# EasyEDA Pro project ProProject_IMUSensorNodes202312.epro, board 6_6_拼板20240123（带编号） (continued)
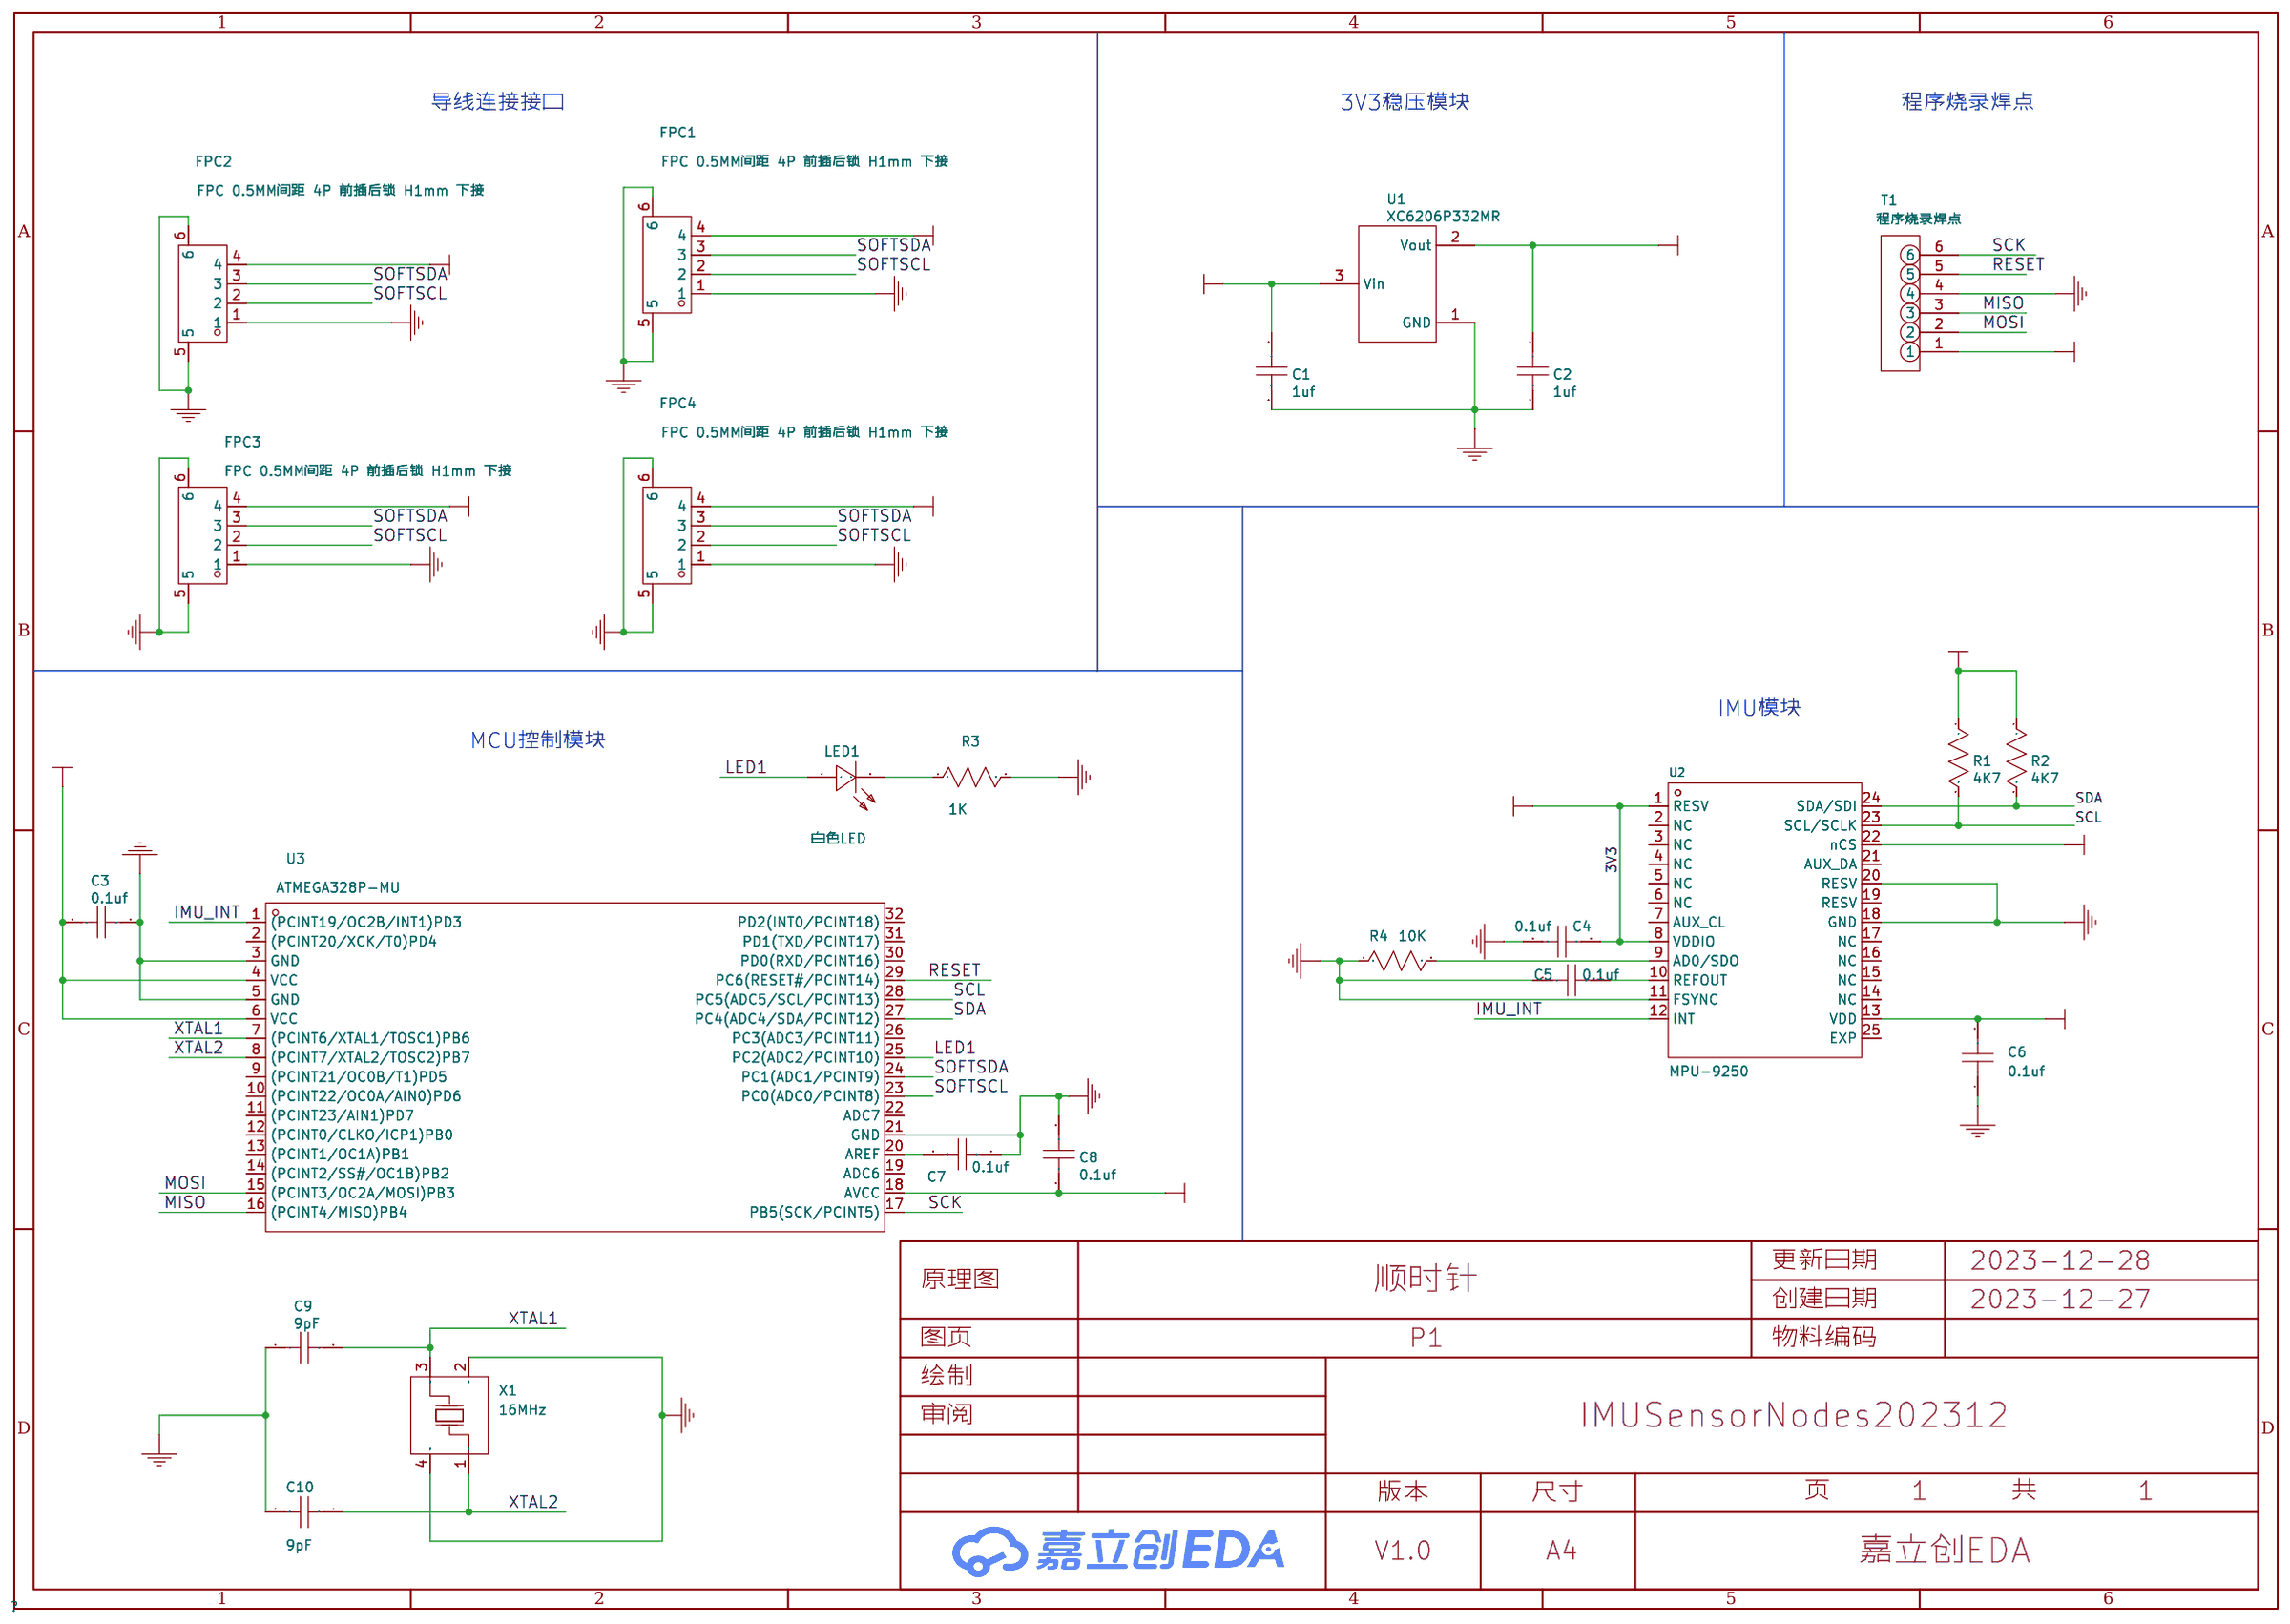
[diagram p0: schematic sheet]
## Routing (per net, layer and track width the routed paths; a pad name or vN(x,y) marks a point on that pad's centre or on a via; arc(x,y) is an arc through that point) (continued)
  Bottom Layer w0.254: 64.55,47.4 64.87,47.72 65.43,47.72 ; 64.55,47.4 64.55,49.81 65.18,50.45 65.18,51.84 64.42,52.61 62.74,52.61 ; 64.55,47.4 64.55,46.66 Designator#776.1 ; Designator#882.22 43.82,37.06 43.47,36.71 v1(43.47,36.35) 43.49,36.33 Designator#477.1 43.49,34.7 46,34.7 46.13,34.57 ; 17.72,38.89 19.29,38.89 ; 17.72,38.89 16.71,38.89 ; 17.72,38.89 arc(17.44,38.78) 17.32,38.5 ; 19.29,38.89 20.01,38.89 ; 19.29,38.89 arc(19.64,38.75) 19.78,38.4 19.78,38.87 ; 44.62,24.78 44.62,25.17 ; 44.62,24.78 Designator#813.1 arc(44.45,25) 44.02,25.17 ; 44.62,24.78 arc(44.74,25.06) 45.02,25.17 ; 1.01,10.7 1.26,10.95 1.3,10.95 ; 1.01,10.7 1.05,10.7 1.3,10.95 ; 1.01,10.7 v1(0.92,10.7) ; Designator#866.2 51.06,60.66 Designator#706.1 ; 73.9,38.89 74.62,38.89 ; 73.9,38.89 72.32,38.89 ; 73.9,38.89 arc(74.25,38.75) 74.39,38.4 74.39,38.87 ; 74.62,38.89 74.65,38.87 ; 74.62,38.89 74.99,38.89 ; 20.96,52.61 21.43,52.61 ; 20.96,52.61 20.38,52.61 ; 20.96,52.61 arc(21.32,52.46) Designator#753.1 ; 21.43,52.61 21.47,52.57 Designator#753.1 ; 21.43,52.61 21.98,52.61 ; 64.55,61.12 64.55,63.53 65.18,64.16 65.18,65.56 64.42,66.32 62.74,66.32 ; 64.55,61.12 64.87,61.44 65.43,61.44 ; 64.55,61.12 64.55,60.38 Designator#716.1 ; 1.01,65.56 1.26,65.81 1.3,65.81 ; 1.01,65.56 1.05,65.56 1.3,65.81 ; 1.01,65.56 v1(0.92,65.56) ; 61.5,66.32 61.73,66.32 arc(62.09,66.17) Designator#723.1 ; v1(75.22,14.89) 74.83,14.51 74.18,14.51 73.92,14.76 Designator#895.18 ; 71.32,25.17 72.32,25.17 ; 71.32,25.17 v1(70.52,25.17) 70.11,24.77 Designator#362.1 ; 71.32,25.17 arc(71.75,25) Designator#883.1 71.93,24.78 ; 72.32,25.17 73.9,25.17 ; 72.32,25.17 arc(72.05,25.06) 71.93,24.78 ; 71.93,65.93 71.93,66.32 ; 71.93,65.93 Designator#881.1 arc(71.75,66.15) 71.32,66.32 ; 71.93,65.93 arc(72.05,66.21) 72.32,66.32 ; Designator#422.1 28.45,50.58 v1(28.35,50.58) ; 28.61,52.1 28.83,52.33 ; 28.61,52.1 Designator#421.1 28.83,52.33 ; 28.61,52.1 28.35,51.84 28.31,51.84 ; 28.61,52.1 28.57,52.1 28.31,51.84 ; 28.83,52.33 29.11,52.61 ; 60.74,11.08 60.74,10.12 Designator#911.8 ; 56.14,66.04 56.42,66.32 ; 56.14,66.04 Designator#409.1 55.91,65.81 ; 56.14,66.04 55.91,65.81 ; Designator#554.1 64.55,19.23 64.55,19.97 ; 37.24,6.25 37.24,5.51 Designator#587.1 ; 37.24,6.25 37.56,6.57 38.12,6.57 ; 37.24,6.25 37.24,8.66 37.88,9.3 37.88,10.7 37.12,11.46 35.44,11.46 ; Designator#706.1 51.06,59.08 50.68,58.7 v1(49.69,58.7) Designator#709.1 ; Designator#706.1 50.93,60.23 50.7,60.23 50.58,60.35 50.58,63.28 51.59,64.29 51.59,65.94 51.21,66.32 49.28,66.32 ; 21.43,80.04 21.47,80 Designator#651.1 ; 21.43,80.04 21.98,80.04 ; 21.43,80.04 20.96,80.04 ; 20.96,66.32 21.43,66.32 ; 20.96,66.32 20.38,66.32 ; 20.96,66.32 arc(21.32,66.17) Designator#693.1 ; 21.43,66.32 21.98,66.32 ; 21.43,66.32 21.47,66.28 Designator#693.1 ; Designator#503.1 78.24,73.94 78.01,73.94 77.88,74.07 77.88,76.99 78.9,78.01 78.9,79.66 78.52,80.04 76.59,80.04 ; Designator#503.1 78.36,72.8 77.98,72.42 v1(76.99,72.42) Designator#506.1 ; Designator#503.1 78.36,74.37 Designator#845.2 ; 9.94,19.97 10.26,20.29 10.82,20.29 ; 9.94,19.97 9.94,22.38 10.57,23.02 10.57,24.41 9.81,25.17 8.13,25.17 ; 9.94,19.97 9.94,19.23 Designator#513.1 ; Designator#333.1 28.45,36.86 v1(28.35,36.86) ; Designator#864.2 23.75,60.66 Designator#686.1 ; 1.3,38.38 1.53,38.61 ; 1.3,38.38 1.05,38.13 1.01,38.13 ; 1.3,38.38 Designator#433.1 1.53,38.61 ; 1.3,38.38 1.26,38.38 1.01,38.13 ; 1.53,38.61 1.81,38.89 ; 21.98,80.04 23.91,80.04 24.29,79.66 24.29,78.01 23.27,76.99 23.27,74.07 23.4,73.94 23.63,73.94 Designator#643.1 ; 21.98,80.04 arc(21.62,79.89) Designator#651.1 ; Designator#883.22 71.12,23.34 70.77,22.99 v1(70.77,22.64) 70.8,22.61 Designator#566.1 70.8,20.98 73.31,20.98 73.44,20.86 ; 56.14,24.9 56.42,25.17 ; 56.14,24.9 Designator#359.1 55.91,24.67 ; 56.14,24.9 55.91,24.67 ; 21.98,52.61 23.91,52.61 24.29,52.23 24.29,50.58 23.27,49.56 23.27,46.64 23.4,46.51 23.63,46.51 Designator#746.1 ; 21.98,52.61 arc(21.62,52.46) Designator#753.1 ; Designator#888.8 6.13,51.27 6.13,52.23 ; v1(69.55,36.86) 69.55,36.91 69.88,37.24 Designator#342.1 ; Designator#763.1 34.93,52.58 34.96,52.61 35.44,52.61 ; Designator#763.1 arc(34.78,52.46) 34.42,52.61 34.19,52.61 ; Designator#763.1 arc(35.08,52.46) 35.44,52.61 ; 75.57,66.32 76.04,66.32 ; 75.57,66.32 74.99,66.32 ; 75.57,66.32 arc(75.93,66.17) Designator#733.1 ; 76.04,66.32 76.08,66.28 Designator#733.1 ; 76.04,66.32 76.59,66.32 ; 28.61,38.38 28.83,38.61 ; 28.61,38.38 28.35,38.13 28.31,38.13 ; 28.61,38.38 Designator#332.1 28.83,38.61 ; 28.61,38.38 28.57,38.38 28.31,38.13 ; 28.83,38.61 29.11,38.89 ; 20.01,38.89 20.38,38.89 ; 20.01,38.89 20.04,38.87 ; 49.28,52.61 51.21,52.61 51.59,52.23 51.59,50.58 50.58,49.56 50.58,46.64 50.7,46.51 50.93,46.51 Designator#766.1 ; 49.28,52.61 48.73,52.61 ; 49.28,52.61 arc(48.92,52.46) Designator#773.1 ; v1(75.22,42.32) 74.83,41.94 74.18,41.94 73.92,42.19 Designator#906.18 ; Designator#686.1 23.75,59.08 23.37,58.7 v1(22.38,58.7) Designator#689.1 ; Designator#686.1 23.63,60.23 23.4,60.23 23.27,60.35 23.27,63.28 24.29,64.29 24.29,65.94 23.91,66.32 21.98,66.32 ; 48.27,52.61 48.73,52.61 ; 48.27,52.61 47.69,52.61 ; 48.27,52.61 arc(48.62,52.46) Designator#773.1 ; 48.73,52.61 48.77,52.57 Designator#773.1 ; Designator#510.1 76.08,80 76.04,80.04 ; Designator#510.1 arc(76.23,79.89) 76.59,80.04 ; Designator#510.1 arc(75.93,79.89) 75.57,80.04 ; Designator#811.6 5.11,61.25 v2(5.11,62.2) 5.17,62.26 5.49,62.26 5.6,62.37 Designator#818.13 ; Designator#597.1 51.06,5.79 Designator#855.2 ; Designator#597.1 50.93,5.36 50.7,5.36 50.58,5.49 50.58,8.41 51.59,9.43 51.59,11.08 51.21,11.46 49.28,11.46 ; Designator#597.1 51.06,4.22 50.68,3.84 v1(49.69,3.84) Designator#600.1 ; Designator#360.1 55.76,23.14 v1(55.66,23.14) ; 64.55,74.83 64.55,74.09 Designator#637.1 ; 64.55,74.83 64.55,77.25 65.18,77.88 65.18,79.28 64.42,80.04 62.74,80.04 ; 64.55,74.83 64.87,75.15 65.43,75.15 ; 18.83,62 18.7,62.13 16.19,62.13 Designator#690.1 16.19,63.76 v1(16.16,63.78) 16.16,64.14 16.51,64.49 Designator#915.22 ; 48.27,66.32 47.69,66.32 ; 48.27,66.32 48.73,66.32 ; 48.27,66.32 arc(48.62,66.17) Designator#713.1 ; 47.69,66.32 47.32,66.32 ; 47.69,66.32 arc(47.26,66.15) 47.09,65.72 ; Designator#407.1 42.58,64.67 42.25,64.34 v1(42.25,64.29) ; Designator#604.1 48.77,11.42 48.73,11.46 ; Designator#604.1 arc(48.92,11.31) 49.28,11.46 ; Designator#604.1 arc(48.62,11.31) 48.27,11.46 ; 35.44,11.46 34.96,11.46 34.93,11.43 Designator#594.1 ; 35.44,11.46 arc(35.08,11.31) Designator#594.1 ; 65.43,34 64.87,34 64.55,33.68 ; 47.09,11.44 47.09,10.97 arc(46.94,11.31) 46.59,11.46 ; 34.19,11.46 34.42,11.46 arc(34.78,11.31) Designator#594.1 ; 38.12,47.72 37.56,47.72 37.24,47.4 ; 34.19,25.17 34.42,25.17 arc(34.78,25.03) Designator#540.1 ; 61.5,25.17 61.73,25.17 arc(62.09,25.03) Designator#559.1 ; Designator#840.2 23.75,33.22 Designator#453.1 ; v1(42.25,9.43) 42.25,9.48 42.58,9.81 Designator#374.1 ; 28.31,79.28 28.35,79.28 28.61,79.53 ; 28.31,79.28 28.57,79.53 28.61,79.53 ; 28.31,79.28 v1(28.22,79.28) ; Designator#394.1 42.8,79.63 v1(43.21,80.04) 44.02,80.04 ; 20.96,80.04 20.38,80.04 ; 20.96,80.04 arc(21.32,79.89) Designator#651.1 ; 20.38,80.04 20.01,80.04 ; 20.38,80.04 arc(19.96,79.86) 19.78,79.44 ; 8.13,38.89 7.65,38.89 7.63,38.87 Designator#450.1 ; 8.13,38.89 9.81,38.89 10.57,38.13 10.57,36.73 9.94,36.1 9.94,33.68 ; 8.13,38.89 arc(7.77,38.74) Designator#450.1 ; v1(1.05,50.58) 1.15,50.58 Designator#416.1 ; Designator#830.22 71.12,37.06 70.77,36.71 v1(70.77,36.35) 70.8,36.33 Designator#497.1 70.8,34.7 73.31,34.7 73.44,34.57 ; 28.61,79.53 28.83,79.76 ; 28.61,79.53 Designator#391.1 28.83,79.76 ; 71.93,79.64 Designator#918.1 arc(71.75,79.86) 71.32,80.04 ; 71.93,79.64 71.93,80.04 ; 71.93,79.64 arc(72.05,79.92) 72.32,80.04 ; 71.93,52.21 71.93,52.61 ; 71.93,52.21 Designator#912.1 arc(71.75,52.43) 71.32,52.61 ; 71.93,52.21 arc(72.05,52.49) 72.32,52.61 ; 6.89,52.61 7.12,52.61 arc(7.48,52.46) Designator#743.1 ; 21.98,66.32 arc(21.62,66.17) Designator#693.1 ; 56.14,52.33 56.42,52.61 ; 56.14,52.33 55.91,52.1 ; 56.14,52.33 Designator#427.1 55.91,52.1 ; 48.73,38.89 49.28,38.89 ; 48.73,38.89 48.77,38.85 Designator#480.1 ; 48.73,38.89 48.27,38.89 ; 49.28,38.89 51.21,38.89 51.59,38.51 51.59,36.86 50.58,35.84 50.58,32.92 50.7,32.8 50.93,32.8 Designator#473.1 ; 49.28,38.89 arc(48.92,38.74) Designator#480.1 ; 44.62,52.21 Designator#897.1 arc(44.45,52.43) 44.02,52.61 ; 44.62,52.21 44.62,52.61 ; 44.62,52.21 arc(44.74,52.49) 45.02,52.61 ; Designator#580.1 v1(22.38,3.84) 23.37,3.84 23.75,4.22 Designator#577.1 ; 74.39,25.15 74.39,24.68 arc(74.25,25.03) 73.9,25.17 ; 28.31,51.84 v1(28.22,51.84) ; 16.71,38.89 v1(15.91,38.89) 15.5,38.48 Designator#329.1 ; 16.71,38.89 arc(17.14,38.71) Designator#923.1 17.32,38.5 ; Designator#877.13 60.21,48.65 60.1,48.54 59.78,48.54 v2(59.72,48.48) 59.72,47.53 Designator#920.6 ; 20.04,52.58 20.01,52.61 ; 20.01,52.61 19.29,52.61 ; 20.01,52.61 20.38,52.61 ; 46.13,48.29 46,48.42 43.49,48.42 Designator#770.1 43.49,50.04 v1(43.47,50.07) 43.47,50.42 43.82,50.78 Designator#897.22 ; 74.65,52.58 74.62,52.61 ; 74.62,52.61 73.9,52.61 ; 74.62,52.61 74.99,52.61 ; 44.02,38.89 v1(43.21,38.89) 42.8,38.48 Designator#335.1 ; 44.02,38.89 45.02,38.89 ; 44.02,38.89 arc(44.45,38.71) Designator#882.1 44.62,38.5 ; 44.62,79.64 Designator#880.1 arc(44.45,79.86) 44.02,80.04 ; 44.62,79.64 44.62,80.04 ; 44.62,79.64 arc(44.74,79.92) 45.02,80.04 ; 47.34,80.02 47.32,80.04 ; 47.32,80.04 47.69,80.04 ; 47.32,80.04 46.59,80.04 ; 8.13,11.46 7.65,11.46 7.63,11.43 Designator#574.1 ; 8.13,11.46 9.81,11.46 10.57,10.7 10.57,9.3 9.94,8.66 9.94,6.25 ; 8.13,11.46 arc(7.77,11.31) Designator#574.1 ; Designator#801.18 73.92,28.48 74.18,28.22 74.83,28.22 v1(75.22,28.6) ; 28.61,10.95 28.35,10.7 28.31,10.7 ; 28.61,10.95 28.83,11.18 ; 28.61,10.95 28.57,10.95 28.31,10.7 ; 28.61,10.95 Designator#370.1 28.83,11.18 ; Designator#400.1 15.5,65.92 v1(15.91,66.32) 16.71,66.32 ; Designator#646.1 v1(22.38,72.42) 23.37,72.42 23.75,72.8 Designator#643.1 ; 6.89,25.17 7.12,25.17 arc(7.48,25.03) Designator#520.1 ; 8.13,80.04 9.81,80.04 10.57,79.28 10.57,77.88 9.94,77.25 9.94,74.83 ; 8.13,80.04 7.65,80.04 7.63,80.01 Designator#634.1 ; 8.13,80.04 arc(7.77,79.89) Designator#634.1 ; 9.94,61.12 10.26,61.44 10.82,61.44 ; 9.94,61.12 9.94,60.38 Designator#676.1 ; 9.94,61.12 9.94,63.53 10.57,64.16 10.57,65.56 9.81,66.32 8.13,66.32 ; 47.69,52.61 47.32,52.61 ; 47.69,52.61 arc(47.26,52.43) 47.09,52 ; Designator#847.2 23.75,19.51 Designator#523.1 ; Designator#551.1 48.77,25.14 48.73,25.17 ; Designator#551.1 arc(48.92,25.03) 49.28,25.17 ; Designator#551.1 arc(48.62,25.03) 48.27,25.17 ; 55.62,24.41 55.87,24.67 55.91,24.67 ; 55.62,24.41 55.66,24.41 55.91,24.67 ; 55.62,24.41 v1(55.53,24.41) ; Designator#523.1 23.63,19.08 23.4,19.08 23.27,19.21 23.27,22.13 24.29,23.14 24.29,24.79 23.91,25.17 21.98,25.17 ; Designator#523.1 23.75,17.94 23.37,17.56 v1(22.38,17.56) Designator#526.1 ; 47.69,80.04 48.27,80.04 ; 47.69,80.04 arc(47.26,79.86) 47.09,79.44 ; Designator#872.2 51.06,46.94 Designator#766.1 ; Designator#620.1 v1(76.99,3.84) 77.98,3.84 78.36,4.22 Designator#617.1 ; Designator#463.1 37.24,32.95 37.24,33.68 ; 55.91,10.95 55.87,10.95 55.62,10.7 ; 55.91,10.95 55.66,10.7 55.62,10.7 ; 55.91,10.95 56.14,11.18 ; 55.91,10.95 Designator#376.1 56.14,11.18 ; 62.74,66.32 62.26,66.32 62.24,66.3 Designator#723.1 ; 62.74,66.32 arc(62.38,66.17) Designator#723.1 ; Designator#419.1 15.27,50.96 14.94,50.63 v1(14.94,50.58) ; Designator#348.1 1.15,23.14 v1(1.05,23.14) ; 16.71,52.61 17.72,52.61 ; 16.71,52.61 v1(15.91,52.61) 15.5,52.2 Designator#418.1 ; 16.71,52.61 arc(17.14,52.43) Designator#890.1 17.32,52.21 ; 17.72,52.61 19.29,52.61 ; 17.72,52.61 arc(17.44,52.49) 17.32,52.21 ; 74.65,80.02 74.62,80.04 ; 74.62,80.04 73.9,80.04 ; 74.62,80.04 74.99,80.04 ; 28.83,66.04 Designator#403.1 28.61,65.81 ; 28.83,66.04 28.61,65.81 ; 28.83,66.04 29.11,66.32 ; Designator#456.1 v1(22.38,31.27) 23.37,31.27 23.75,31.65 Designator#453.1 ; 61.5,11.46 61.73,11.46 arc(62.09,11.31) Designator#614.1 ; v1(55.53,79.28) 55.62,79.28 ; 55.62,79.28 55.87,79.53 55.91,79.53 ; 55.62,79.28 55.66,79.28 55.91,79.53 ; 28.83,11.18 29.11,11.46 ; Designator#868.2 78.36,60.66 Designator#726.1 ; Designator#428.1 55.76,50.58 v1(55.66,50.58) ; 62.74,11.46 62.26,11.46 62.24,11.43 Designator#614.1 ; 62.74,11.46 64.42,11.46 65.18,10.7 65.18,9.3 64.55,8.66 64.55,6.25 ; 62.74,11.46 arc(62.38,11.31) Designator#614.1 ; Designator#877.8 60.74,51.27 60.74,52.23 ; 28.83,79.76 29.11,80.04 ; 73.44,62 73.31,62.13 70.8,62.13 Designator#730.1 70.8,63.76 v1(70.77,63.78) 70.77,64.14 71.12,64.49 Designator#881.22 ; 48.73,66.32 48.77,66.28 Designator#713.1 ; 48.73,66.32 49.28,66.32 ; Designator#862.2 51.06,74.37 Designator#666.1 ; 19.29,66.32 20.01,66.32 ; 19.29,66.32 17.72,66.32 ; 19.29,66.32 arc(19.64,66.18) 19.78,65.83 19.78,66.3 ; 20.01,66.32 20.04,66.3 ; 20.01,66.32 20.38,66.32 ; 76.04,80.04 76.59,80.04 ; 76.04,80.04 75.57,80.04 ; 34.19,66.32 34.42,66.32 arc(34.78,66.17) Designator#703.1 ; Designator#425.1 42.58,50.96 42.25,50.63 v1(42.25,50.58) ; 44.62,65.93 Designator#314.1 arc(44.45,66.15) 44.02,66.32 ; 44.62,65.93 44.62,66.32 ; 44.62,65.93 arc(44.74,66.21) 45.02,66.32 ; 44.02,52.61 45.02,52.61 ; 44.02,52.61 v1(43.21,52.61) 42.8,52.2 Designator#424.1 ; 45.02,52.61 46.59,52.61 ; 55.91,79.53 Designator#385.1 56.14,79.76 ; 55.91,79.53 56.14,79.76 ; Designator#713.1 arc(48.92,66.17) 49.28,66.32 ; 60.74,79.66 60.74,78.7 Designator#814.8 ; Designator#766.1 51.06,45.37 50.68,44.99 v1(49.69,44.99) Designator#769.1 ; 17.72,11.46 19.29,11.46 ; 17.72,11.46 16.71,11.46 ; 17.72,11.46 arc(17.44,11.34) 17.32,11.06 ; 19.29,11.46 20.01,11.46 ; 19.29,11.46 arc(19.64,11.31) 19.78,10.97 19.78,11.44 ; 44.02,11.46 v1(43.21,11.46) 42.8,11.05 Designator#373.1 ; 44.02,11.46 45.02,11.46 ; 44.02,11.46 arc(44.45,11.28) Designator#326.1 44.62,11.06 ; 44.2,78.21 43.82,78.21 43.47,77.86 v1(43.47,77.5) 43.49,77.47 Designator#670.1 43.49,75.85 46,75.85 46.13,75.72 ; Designator#389.1 15.27,78.39 14.94,78.06 v1(14.94,78.01) ; 45.02,38.89 46.59,38.89 ; 45.02,38.89 arc(44.74,38.78) 44.62,38.5 ; 35.44,80.04 34.96,80.04 34.93,80.01 Designator#663.1 ; 35.44,80.04 37.12,80.04 37.88,79.28 37.88,77.88 37.24,77.25 37.24,74.83 ; 35.44,80.04 arc(35.08,79.89) Designator#663.1 ; 1.53,79.76 Designator#382.1 1.3,79.53 ; 1.53,79.76 1.3,79.53 ; 1.53,79.76 1.81,80.04 ; 71.93,24.78 71.93,25.17 ; 73.9,66.32 74.62,66.32 ; 73.9,66.32 72.32,66.32 ; 73.9,66.32 arc(74.25,66.18) 74.39,65.83 74.39,66.3 ; 74.62,66.32 74.99,66.32 ; 74.62,66.32 74.65,66.3 ; Designator#453.1 23.63,32.8 23.4,32.8 23.27,32.92 23.27,35.84 24.29,36.86 24.29,38.51 23.91,38.89 21.98,38.89 ; 17.72,80.04 19.29,80.04 ; 17.72,80.04 16.71,80.04 ; 17.72,80.04 arc(17.44,79.92) 17.32,79.64 ; 19.29,80.04 20.01,80.04 ; 19.29,80.04 arc(19.64,79.89) 19.78,79.55 19.78,80.02 ; Designator#909.13 32.91,21.22 32.8,21.11 32.48,21.11 v2(32.42,21.05) 32.42,20.1 Designator#321.6 ; 9.94,33.68 10.26,34 10.82,34 ; 9.94,33.68 9.94,32.95 Designator#796.1 ; v1(42.25,23.14) 42.25,23.19 42.58,23.52 Designator#357.1 ; 16.71,80.04 v1(15.91,80.04) 15.5,79.63 Designator#388.1 ; 16.71,80.04 arc(17.14,79.86) Designator#886.1 17.32,79.64 ; 16.89,78.21 16.51,78.21 16.16,77.86 v1(16.16,77.5) 16.19,77.47 Designator#647.1 16.19,75.85 18.7,75.85 18.83,75.72 ; Designator#663.1 arc(34.78,79.89) 34.42,80.04 34.19,80.04 ; Designator#565.1 v1(76.99,17.56) 77.98,17.56 78.36,17.94 Designator#562.1 ; Designator#473.1 51.06,31.65 50.68,31.27 v1(49.69,31.27) Designator#476.1 ; Designator#473.1 51.06,33.22 Designator#842.2 ; 1.3,52.1 Designator#415.1 1.53,52.33 ; 1.3,52.1 1.26,52.1 1.01,51.84 ; 1.3,52.1 1.53,52.33 ; 1.3,52.1 1.05,51.84 1.01,51.84 ; 76.04,11.46 76.59,11.46 ; 76.04,11.46 75.57,11.46 ; 76.04,11.46 76.08,11.42 Designator#624.1 ; 76.59,11.46 78.52,11.46 78.9,11.08 78.9,9.43 77.88,8.41 77.88,5.49 78.01,5.36 78.24,5.36 Designator#617.1 ; 76.59,11.46 arc(76.23,11.31) Designator#624.1 ; 20.01,11.46 20.38,11.46 ; 20.01,11.46 20.04,11.44 ; 20.38,11.46 20.96,11.46 ; 20.38,11.46 arc(19.96,11.28) 19.78,10.86 ; Designator#345.1 69.88,78.39 69.55,78.06 v1(69.55,78.01) ; 71.93,38.5 Designator#830.1 arc(71.75,38.71) 71.32,38.89 ; 71.93,38.5 71.93,38.89 ; 71.93,38.5 arc(72.05,38.78) 72.32,38.89 ; 18.83,20.86 18.7,20.98 16.19,20.98 Designator#527.1 16.19,22.61 v1(16.16,22.64) 16.16,22.99 16.51,23.34 Designator#836.22 ; Designator#819.13 60.21,62.37 60.1,62.26 59.78,62.26 v2(59.72,62.2) 59.72,61.25 Designator#896.6 ; 71.93,11.06 Designator#826.1 arc(71.75,11.28) 71.32,11.46 ; 71.93,11.06 71.93,11.46 ; 71.93,11.06 arc(72.05,11.34) 72.32,11.46 ; 76.59,25.17 78.52,25.17 78.9,24.79 78.9,23.14 77.88,22.13 77.88,19.21 78.01,19.08 78.24,19.08 Designator#562.1 ; 76.59,25.17 76.04,25.17 ; 76.59,25.17 arc(76.23,25.03) Designator#445.1 ; 1.3,65.81 Designator#397.1 1.53,66.04 ; 1.3,65.81 1.53,66.04 ; 48.73,80.04 48.77,80 Designator#673.1 ; 48.73,80.04 48.27,80.04 ; 48.73,80.04 49.28,80.04 ; Designator#746.1 23.75,46.94 Designator#870.2 ; Designator#746.1 23.75,45.37 23.37,44.99 v1(22.38,44.99) Designator#749.1 ; 6.13,11.08 6.13,10.12 Designator#438.8 ; 71.32,66.32 72.32,66.32 ; 71.32,66.32 v1(70.52,66.32) 70.11,65.92 Designator#412.1 ; v1(0.92,51.84) 1.01,51.84 ; 55.91,65.81 55.66,65.56 55.62,65.56 ; 55.91,65.81 55.87,65.81 55.62,65.56 ; 35.44,25.17 34.96,25.17 34.93,25.15 Designator#540.1 ; 35.44,25.17 37.12,25.17 37.88,24.41 37.88,23.02 37.24,22.38 37.24,19.97 ; 35.44,25.17 arc(35.08,25.03) Designator#540.1 ; 75.57,38.89 74.99,38.89 ; 75.57,38.89 76.04,38.89 ; 75.57,38.89 arc(75.93,38.74) Designator#500.1 ; 74.99,38.89 arc(74.57,38.71) 74.39,38.29 ; 33.43,65.94 33.43,64.99 Designator#878.8 ; 76.04,38.89 76.59,38.89 ; 76.04,38.89 76.08,38.85 Designator#500.1 ; 76.59,38.89 78.52,38.89 78.9,38.51 78.9,36.86 77.88,35.84 77.88,32.92 78.01,32.8 78.24,32.8 Designator#493.1 ; 76.59,38.89 arc(76.23,38.74) Designator#500.1 ; v1(1.05,36.86) 1.15,36.86 Designator#434.1 ; Designator#729.1 v1(76.99,58.7) 77.98,58.7 78.36,59.08 Designator#726.1 ; 35.44,52.61 37.12,52.61 37.88,51.84 37.88,50.45 37.24,49.81 37.24,47.4 ; 45.02,25.17 46.59,25.17 ; 45.02,25.17 44.02,25.17 ; 46.59,25.17 47.32,25.17 ; 46.59,25.17 arc(46.94,25.03) 47.09,24.68 47.09,25.15 ; Designator#351.1 15.27,23.52 14.94,23.19 v1(14.94,23.14) ; Designator#341.1 70.11,38.48 v1(70.52,38.89) 71.32,38.89 ; Designator#398.1 1.15,64.29 v1(1.05,64.29) ; Designator#325.6 5.11,74.97 v2(5.11,75.91) 5.17,75.97 5.49,75.97 5.6,76.09 Designator#437.13 ; 33.43,24.79 33.43,23.84 Designator#909.8 ; Designator#793.1 76.08,52.57 76.04,52.61 ; Designator#793.1 arc(75.93,52.46) 75.57,52.61 ; Designator#793.1 arc(76.23,52.46) 76.59,52.61 ; Designator#319.13 32.91,48.65 32.8,48.54 32.48,48.54 v2(32.42,48.48) 32.42,47.53 Designator#916.6 ; 44.02,25.17 v1(43.21,25.17) 42.8,24.77 Designator#356.1 ; Designator#543.1 50.93,19.08 50.7,19.08 50.58,19.21 50.58,22.13 51.59,23.14 51.59,24.79 51.21,25.17 49.28,25.17 ; Designator#543.1 51.06,19.51 Designator#849.2 ; Designator#543.1 51.06,17.94 50.68,17.56 v1(49.69,17.56) Designator#546.1 ; 48.27,80.04 arc(48.62,79.89) Designator#673.1 ; 9.94,74.83 9.94,74.09 Designator#627.1 ; 9.94,74.83 10.26,75.15 10.82,75.15 ; Designator#493.1 78.36,33.22 Designator#844.2 ; Designator#493.1 78.36,31.65 77.98,31.27 v1(76.99,31.27) Designator#496.1 ; Designator#404.1 28.45,64.29 v1(28.35,64.29) ; Designator#548.1 62.24,80.01 62.26,80.04 62.74,80.04 ; Designator#548.1 arc(62.38,79.89) 62.74,80.04 ; Designator#548.1 arc(62.09,79.89) 61.73,80.04 61.5,80.04 ; 75.57,52.61 74.99,52.61 ; 75.57,52.61 76.04,52.61 ; 74.99,52.61 arc(74.57,52.43) 74.39,52 ; 48.27,11.46 47.69,11.46 ; 48.27,11.46 48.73,11.46 ; 47.69,11.46 47.32,11.46 ; 47.69,11.46 arc(47.26,11.28) 47.09,10.86 ; 44.62,11.06 44.62,11.46 ; 44.62,11.06 arc(44.74,11.34) 45.02,11.46 ; Designator#810.18 73.92,69.62 74.18,69.37 74.83,69.37 v1(75.22,69.75) ; 6.89,80.04 7.12,80.04 arc(7.48,79.89) Designator#634.1 ; 17.32,24.78 17.32,25.17 ; 17.32,24.78 Designator#836.1 arc(17.14,25) 16.71,25.17 ; 17.32,24.78 arc(17.44,25.06) 17.72,25.17 ; Designator#919.13 60.21,34.94 60.1,34.83 59.78,34.83 v2(59.72,34.76) 59.72,33.82 Designator#892.6 ; 1.53,24.9 Designator#347.1 1.3,24.67 ; 1.53,24.9 1.3,24.67 ; 1.53,24.9 1.81,25.17 ; Designator#736.1 9.94,46.66 9.94,47.4 ; 74.65,25.15 74.62,25.17 ; 74.62,25.17 74.99,25.17 ; 74.62,25.17 73.9,25.17 ; 9.94,47.4 10.26,47.72 10.82,47.72 ; 9.94,47.4 9.94,49.81 10.57,50.45 10.57,51.84 9.81,52.61 8.13,52.61 ; 76.04,52.61 76.59,52.61 ; 71.32,52.61 v1(70.52,52.61) 70.11,52.2 Designator#430.1 ; 71.32,52.61 72.32,52.61 ; 33.43,38.51 33.43,37.56 Designator#921.8 ; 73.9,52.61 72.32,52.61 ; 73.9,52.61 arc(74.25,52.46) 74.39,52.11 74.39,52.58 ; 20.01,80.04 20.04,80.02 ; 75.57,11.46 74.99,11.46 ; 75.57,11.46 arc(75.93,11.31) Designator#624.1 ; 74.99,11.46 74.62,11.46 ; 74.99,11.46 arc(74.57,11.28) 74.39,10.86 ; v1(28.35,23.14) 28.45,23.14 Designator#354.1 ; 19.78,25.15 19.78,24.68 arc(19.64,25.03) 19.29,25.17 ; Designator#313.6 32.42,74.97 v2(32.42,75.91) 32.48,75.97 32.8,75.97 32.91,76.09 Designator#901.13 ; 47.34,38.87 47.32,38.89 ; 47.32,38.89 47.69,38.89 ; 47.32,38.89 46.59,38.89 ; 1.3,79.53 1.05,79.28 1.01,79.28 ; 1.3,79.53 1.26,79.53 1.01,79.28 ; v1(55.66,78.01) 55.76,78.01 Designator#386.1 ; 16.71,66.32 17.72,66.32 ; 16.71,66.32 arc(17.14,66.15) Designator#915.1 17.32,65.93 ; Designator#567.1 9.94,5.51 9.94,6.25 ; 38.12,20.29 37.56,20.29 37.24,19.97 ; v1(55.66,36.86) 55.76,36.86 Designator#339.1 ; Designator#438.13 5.6,7.51 5.49,7.4 5.17,7.4 v2(5.11,7.33) 5.11,6.39 Designator#917.6 ; Designator#406.1 42.8,65.92 v1(43.21,66.32) 44.02,66.32 ; Designator#643.1 23.75,74.37 Designator#860.2 ; 55.62,38.13 55.66,38.13 55.91,38.38 ; 55.62,38.13 55.87,38.38 55.91,38.38 ; 55.62,38.13 v1(55.53,38.13) ; Designator#888.13 5.6,48.65 5.49,48.54 5.17,48.54 v2(5.11,48.48) 5.11,47.53 Designator#803.6 ; 48.73,25.17 49.28,25.17 ; 48.73,25.17 48.27,25.17 ; Designator#533.1 37.24,19.23 37.24,19.97 ; 60.74,38.51 60.74,37.56 Designator#919.8 ; 47.09,80.02 47.09,79.55 arc(46.94,79.89) 46.59,80.04 ; 1.53,66.04 1.81,66.32 ; Designator#885.18 46.62,14.76 46.87,14.51 47.53,14.51 v1(47.91,14.89) ; 48.27,38.89 47.69,38.89 ; 48.27,38.89 arc(48.62,38.74) Designator#480.1 ; 47.69,38.89 arc(47.26,38.71) 47.09,38.29 ; 76.59,66.32 78.52,66.32 78.9,65.94 78.9,64.29 77.88,63.28 77.88,60.35 78.01,60.23 78.24,60.23 Designator#726.1 ; 76.59,66.32 arc(76.23,66.17) Designator#733.1 ; 37.24,61.12 37.24,63.53 37.88,64.16 37.88,65.56 37.12,66.32 35.44,66.32 ; 37.24,61.12 37.56,61.44 38.12,61.44 ; 37.24,61.12 37.24,60.38 Designator#696.1 ; v1(1.05,9.43) 1.15,9.43 Designator#365.1 ; Designator#336.1 42.58,37.24 42.25,36.91 v1(42.25,36.86) ; Designator#827.6 32.42,33.82 v2(32.42,34.76) 32.48,34.83 32.8,34.83 32.91,34.94 Designator#921.13 ; Designator#470.1 34.93,38.87 34.96,38.89 35.44,38.89 ; Designator#470.1 arc(34.78,38.74) 34.42,38.89 34.19,38.89 ; Designator#470.1 arc(35.08,38.74) 35.44,38.89 ; Designator#559.1 62.24,25.15 62.26,25.17 62.74,25.17 ; Designator#559.1 arc(62.38,25.03) 62.74,25.17 ; Designator#901.8 33.43,78.7 33.43,79.66 ; 8.13,52.61 7.65,52.61 7.63,52.58 Designator#743.1 ; 8.13,52.61 arc(7.77,52.46) Designator#743.1 ; 74.99,66.32 arc(74.57,66.15) 74.39,65.72 ; 1.3,24.67 1.26,24.67 1.01,24.41 ; 1.3,24.67 1.05,24.41 1.01,24.41 ; 48.27,25.17 47.69,25.17 ; 47.69,25.17 47.32,25.17 ; 47.69,25.17 arc(47.26,25) 47.09,24.57 ; Designator#368.1 15.27,9.81 14.94,9.48 v1(14.94,9.43) ; v1(47.91,28.6) 47.53,28.22 46.87,28.22 46.62,28.48 Designator#839.18 ; 47.32,66.32 46.59,66.32 ; 47.32,66.32 47.34,66.3 ; v1(0.92,24.41) 1.01,24.41 ; 47.32,52.61 47.34,52.58 ; 47.32,52.61 46.59,52.61 ; 55.62,51.84 55.87,52.1 55.91,52.1 ; 55.62,51.84 55.66,51.84 55.91,52.1 ; 55.62,51.84 v1(55.53,51.84) ; 48.73,11.46 49.28,11.46 ; 56.14,11.18 56.42,11.46 ; 71.32,38.89 72.32,38.89 ; Designator#819.8 60.74,64.99 60.74,65.94 ; Designator#904.18 19.31,14.76 19.57,14.51 20.22,14.51 v1(20.6,14.89) ; 73.44,75.72 73.31,75.85 70.8,75.85 Designator#507.1 70.8,77.47 v1(70.77,77.5) 70.77,77.86 71.12,78.21 71.5,78.21 ; 65.43,20.29 64.87,20.29 64.55,19.97 ; 56.14,38.61 Designator#338.1 55.91,38.38 ; 56.14,38.61 55.91,38.38 ; 56.14,38.61 56.42,38.89 ; v1(14.94,64.29) 14.94,64.34 15.27,64.67 Designator#401.1 ; 1.53,11.18 1.81,11.46 ; 1.53,11.18 1.3,10.95 ; 1.53,11.18 Designator#364.1 1.3,10.95 ; v1(47.91,56.04) 47.53,55.66 46.87,55.66 46.62,55.91 Designator#324.18 ; 56.14,79.76 56.42,80.04 ; Designator#330.1 15.27,37.24 14.94,36.91 v1(14.94,36.86) ; Designator#818.8 6.13,64.99 6.13,65.94 ; Designator#806.6 32.42,6.39 v2(32.42,7.33) 32.48,7.4 32.8,7.4 32.91,7.51 Designator#831.13 ; 37.24,33.68 37.24,36.1 37.88,36.73 37.88,38.13 37.12,38.89 35.44,38.89 ; 37.24,33.68 37.56,34 38.12,34 ; 19.29,25.17 20.01,25.17 ; 19.29,25.17 17.72,25.17 ; 20.01,25.17 20.04,25.15 ; 20.01,25.17 20.38,25.17 ; Designator#326.22 43.82,9.63 43.47,9.28 v1(43.47,8.92) 43.49,8.89 Designator#601.1 43.49,7.27 46,7.27 46.13,7.14 ; 64.55,33.68 64.55,32.95 Designator#483.1 ; 64.55,33.68 64.55,36.1 65.18,36.73 65.18,38.13 64.42,38.89 62.74,38.89 ; 28.31,65.56 28.57,65.81 28.61,65.81 ; 28.31,65.56 v1(28.22,65.56) ; 28.31,65.56 28.35,65.56 28.61,65.81 ; v1(28.22,24.41) 28.31,24.41 ; 28.31,24.41 28.35,24.41 28.61,24.67 ; 28.31,24.41 28.57,24.67 28.61,24.67 ; Designator#669.1 v1(49.69,72.42) 50.68,72.42 51.06,72.8 Designator#666.1 ; 8.13,25.17 7.65,25.17 7.63,25.15 Designator#520.1 ; 8.13,25.17 arc(7.77,25.03) Designator#520.1 ; 33.43,52.23 33.43,51.27 Designator#319.8 ; Designator#379.1 70.11,11.05 v1(70.52,11.46) 71.32,11.46 ; 73.44,48.29 73.31,48.42 70.8,48.42 Designator#790.1 70.8,50.04 v1(70.77,50.07) 70.77,50.42 71.12,50.78 Designator#912.22 ; Designator#857.2 78.36,5.79 Designator#617.1 ; 55.62,65.56 v1(55.53,65.56) ; v1(20.6,42.32) 20.22,41.94 19.57,41.94 19.31,42.19 Designator#902.18 ; 73.9,80.04 72.32,80.04 ; 73.9,80.04 arc(74.25,79.89) 74.39,79.55 74.39,80.02 ; Designator#820.18 19.31,69.62 19.57,69.37 20.22,69.37 v1(20.6,69.75) ; Designator#826.22 71.12,9.63 70.77,9.28 v1(70.77,8.92) 70.8,8.89 Designator#621.1 70.8,7.27 73.31,7.27 73.44,7.14 ; 10.82,6.57 10.26,6.57 9.94,6.25 ; 35.44,66.32 34.96,66.32 34.93,66.3 Designator#703.1 ; 35.44,66.32 arc(35.08,66.17) Designator#703.1 ; 19.29,52.61 arc(19.64,52.46) 19.78,52.11 19.78,52.58 ; 21.43,11.46 21.98,11.46 ; 21.43,11.46 20.96,11.46 ; 21.43,11.46 21.47,11.42 Designator#584.1 ; 21.98,11.46 23.91,11.46 24.29,11.08 24.29,9.43 23.27,8.41 23.27,5.49 23.4,5.36 23.63,5.36 Designator#577.1 ; 21.98,11.46 arc(21.62,11.31) Designator#584.1 ; 62.74,52.61 62.26,52.61 62.24,52.58 Designator#783.1 ; 62.74,52.61 arc(62.38,52.46) Designator#783.1 ; 45.02,11.46 46.59,11.46 ; Designator#666.1 50.93,73.94 50.7,73.94 50.58,74.07 50.58,76.99 51.59,78.01 51.59,79.66 51.21,80.04 49.28,80.04 ; v1(69.55,23.14) 69.55,23.19 69.88,23.52 Designator#363.1 ; 37.24,74.83 37.56,75.15 38.12,75.15 ; 37.24,74.83 37.24,74.09 Designator#656.1 ; 71.32,80.04 v1(70.52,80.04) 70.11,79.63 Designator#344.1 ; 71.32,80.04 72.32,80.04 ; Designator#822.18 19.31,28.48 19.57,28.22 20.22,28.22 v1(20.6,28.6) ; Designator#317.8 6.13,37.56 6.13,38.51 ; 17.72,66.32 arc(17.44,66.21) 17.32,65.93 ; v1(20.6,56.04) 20.22,55.66 19.57,55.66 19.31,55.91 Designator#835.18 ; 17.32,52.21 17.32,52.61 ; Designator#923.22 16.51,37.06 16.16,36.71 v1(16.16,36.35) 16.19,36.33 Designator#457.1 16.19,34.7 18.7,34.7 18.83,34.57 ; Designator#837.6 5.11,20.1 v2(5.11,21.05) 5.17,21.11 5.49,21.11 5.6,21.22 Designator#318.13 ; Designator#437.8 6.13,78.7 6.13,79.66 ; 46.59,66.32 45.02,66.32 ; 46.59,66.32 arc(46.94,66.18) 47.09,65.83 47.09,66.3 ; 6.89,11.46 7.12,11.46 arc(7.48,11.31) Designator#574.1 ; 74.62,11.46 73.9,11.46 ; 74.62,11.46 74.65,11.44 ; Designator#431.1 69.88,50.96 69.55,50.63 v1(69.55,50.58) ; 20.96,11.46 arc(21.32,11.31) Designator#584.1 ; 75.57,25.17 76.04,25.17 ; 75.57,25.17 74.99,25.17 ; 75.57,25.17 arc(75.93,25.03) Designator#445.1 ; 76.04,25.17 76.08,25.14 Designator#445.1 ; 47.09,52.58 47.09,52.11 arc(46.94,52.46) 46.59,52.61 ; 20.96,38.89 21.43,38.89 ; 20.96,38.89 20.38,38.89 ; 20.96,38.89 arc(21.32,38.74) Designator#460.1 ; 21.43,38.89 21.47,38.85 Designator#460.1 ; 21.43,38.89 21.98,38.89 ; 44.02,80.04 45.02,80.04 ; 62.74,38.89 62.26,38.89 62.24,38.87 Designator#490.1 ; 62.74,38.89 arc(62.38,38.74) Designator#490.1 ; 74.99,25.17 arc(74.57,25) 74.39,24.57 ; Designator#890.22 16.51,50.78 16.16,50.42 v1(16.16,50.07) 16.19,50.04 Designator#750.1 16.19,48.42 18.7,48.42 18.83,48.29 ; 20.38,52.61 arc(19.96,52.43) 19.78,52 ; Designator#410.1 55.76,64.29 v1(55.66,64.29) ; 47.32,11.46 46.59,11.46 ; 47.32,11.46 47.34,11.44 ; 1.53,52.33 1.81,52.61 ; 76.59,52.61 78.52,52.61 78.9,52.23 78.9,50.58 77.88,49.56 77.88,46.64 78.01,46.51 78.24,46.51 Designator#786.1 ; Designator#789.1 v1(76.99,44.99) 77.98,44.99 78.36,45.37 Designator#786.1 ; 8.13,66.32 7.65,66.32 7.63,66.3 Designator#683.1 ; 8.13,66.32 arc(7.77,66.17) Designator#683.1 ; Designator#377.1 55.76,9.43 v1(55.66,9.43) ; 21.98,38.89 arc(21.62,38.74) Designator#460.1 ; Designator#683.1 arc(7.48,66.17) 7.12,66.32 6.89,66.32 ; 16.71,25.17 v1(15.91,25.17) 15.5,24.77 Designator#350.1 ; 16.71,25.17 17.72,25.17 ; 44.02,66.32 45.02,66.32 ; Designator#913.18 19.31,1.04 19.57,0.79 20.22,0.79 v1(20.6,1.17) ; Designator#814.13 60.21,76.09 60.1,75.97 59.78,75.97 v2(59.72,75.91) 59.72,74.97 Designator#903.6 ; 64.55,6.25 64.87,6.57 65.43,6.57 ; 64.55,6.25 64.55,5.51 Designator#607.1 ; 17.32,11.06 17.32,11.46 ; 17.32,11.06 Designator#323.1 arc(17.14,11.28) 16.71,11.46 ; 17.32,65.93 17.32,66.32 ; 20.96,25.17 20.38,25.17 ; 20.96,25.17 21.43,25.17 ; 20.96,25.17 arc(21.32,25.03) Designator#530.1 ; 20.38,25.17 arc(19.96,25) 19.78,24.57 ; 46.13,20.86 46,20.98 43.49,20.98 Designator#547.1 43.49,22.61 v1(43.47,22.64) 43.47,22.99 43.82,23.34 Designator#813.22 ; Designator#323.22 16.51,9.63 16.16,9.28 v1(16.16,8.92) 16.19,8.89 Designator#581.1 16.19,7.27 18.7,7.27 18.83,7.14 ; 61.5,52.61 61.73,52.61 arc(62.09,52.46) Designator#783.1 ; 6.13,24.79 6.13,23.84 Designator#318.8 ; 73.9,11.46 72.32,11.46 ; 73.9,11.46 arc(74.25,11.31) 74.39,10.97 74.39,11.44 ; Designator#673.1 arc(48.92,79.89) 49.28,80.04 ; 33.43,11.08 33.43,10.12 Designator#831.8 ; 74.99,80.04 75.57,80.04 ; 74.99,80.04 arc(74.57,79.86) 74.39,79.44 ; 46.13,62 46,62.13 43.49,62.13 Designator#710.1 43.49,63.76 v1(43.47,63.78) 43.47,64.14 43.82,64.49 Designator#314.22 ; v1(28.35,78.01) 28.45,78.01 Designator#392.1 ; v1(75.22,56.04) 74.83,55.66 74.18,55.66 73.92,55.91 Designator#809.18 ; 37.24,47.4 37.24,46.66 Designator#756.1 ; 28.61,24.67 28.83,24.9 ; 28.61,24.67 Designator#353.1 28.83,24.9 ; 44.62,38.5 44.62,38.89 ; Designator#829.6 59.72,20.1 v2(59.72,21.05) 59.78,21.11 60.1,21.11 60.21,21.22 Designator#900.13 ; Designator#450.1 arc(7.48,38.74) 7.12,38.89 6.89,38.89 ; 46.59,80.04 45.02,80.04 ; Designator#910.18 73.92,1.04 74.18,0.79 74.83,0.79 v1(75.22,1.17) ; 71.32,11.46 72.32,11.46 ; 47.32,25.17 47.34,25.15 ; Designator#577.1 23.75,5.79 Designator#853.2 ; 28.31,10.7 v1(28.22,10.7) ; 17.32,79.64 17.32,80.04 ; v1(42.25,78.01) 42.25,78.06 42.58,78.39 Designator#395.1 ; 20.38,66.32 arc(19.96,66.15) 19.78,65.72 ; Designator#878.13 32.91,62.37 32.8,62.26 32.48,62.26 v2(32.42,62.2) 32.42,61.25 Designator#808.6 ; 20.38,38.89 arc(19.96,38.71) 19.78,38.29 ; 46.59,38.89 arc(46.94,38.75) 47.09,38.4 47.09,38.87 ; Designator#380.1 69.88,9.81 69.55,9.48 v1(69.55,9.43) ; Designator#786.1 78.36,46.94 Designator#874.2 ; v1(0.92,79.28) 1.01,79.28 ; Designator#530.1 21.47,25.14 21.43,25.17 ; Designator#530.1 arc(21.62,25.03) 21.98,25.17 ; Designator#371.1 28.45,9.43 v1(28.35,9.43) ; Designator#562.1 78.36,19.51 Designator#851.2 ; v1(69.55,64.29) 69.55,64.34 69.88,64.67 Designator#413.1 ; v1(55.53,10.7) 55.62,10.7 ; 16.71,11.46 v1(15.91,11.46) 15.5,11.05 Designator#367.1 ; 1.01,38.13 v1(0.92,38.13) ; Designator#440.6 5.11,33.82 v2(5.11,34.76) 5.17,34.83 5.49,34.83 5.6,34.94 Designator#317.13 ; Designator#832.6 59.72,6.39 v2(59.72,7.33) 59.78,7.4 60.1,7.4 60.21,7.51 Designator#911.13 ; 17.32,38.5 17.32,38.89 ; v1(28.22,38.13) 28.31,38.13 ; Designator#322.18 46.62,42.19 46.87,41.94 47.53,41.94 v1(47.91,42.32) ; 21.43,25.17 21.98,25.17 ; v1(47.91,1.17) 47.53,0.79 46.87,0.79 46.62,1.04 Designator#838.18 ; 61.5,38.89 61.73,38.89 arc(62.09,38.74) Designator#490.1 ; 62.74,25.17 64.42,25.17 65.18,24.41 65.18,23.02 64.55,22.38 64.55,19.97 ; 60.74,24.79 60.74,23.84 Designator#900.8 ; Designator#383.1 1.15,78.01 v1(1.05,78.01) ; Designator#889.18 46.62,69.62 46.87,69.37 47.53,69.37 v1(47.91,69.75) ; 28.83,24.9 29.11,25.17
  vias: v1(6.67,69.67) v1(6.67,55.96) v1(6.67,42.24) v1(6.67,28.53) v1(6.67,14.81) v1(6.67,1.09) v1(8.48,71.91) v1(8.48,58.19) v1(8.48,44.48) v1(8.48,30.76) v1(8.48,17.05) v1(8.48,3.33) v1(33.98,69.67) v1(33.98,55.96) v1(33.98,42.24) v1(33.98,28.53) v1(33.98,14.81) v1(33.98,1.09) v1(35.79,71.91) v1(35.79,58.19) v1(35.79,44.48) v1(35.79,30.76) v1(35.79,17.05) v1(35.79,3.33) v1(61.28,69.67) v1(61.28,55.96) v1(61.28,42.24) v1(61.28,28.53) v1(61.28,14.81) v1(61.28,1.09) v1(63.09,71.91) v1(63.09,58.19) v1(63.09,44.48) v1(63.09,30.76) v1(63.09,17.05) v1(63.09,3.33) v2(3.2,75.89) v2(3.2,62.17) v2(3.2,48.46) v2(3.2,34.74) v2(3.2,21.02) v2(3.2,7.31) v2(30.5,75.89) v2(30.5,62.17) v2(30.5,48.46) v2(30.5,34.74) v2(30.5,21.02) v2(30.5,7.31) v2(57.81,75.89) v2(57.81,62.17) v2(57.81,48.46) v2(57.81,34.74) v2(57.81,21.02) v2(57.81,7.31)
